# EasyEDA Pro project 智能车.eprj, board PCB4
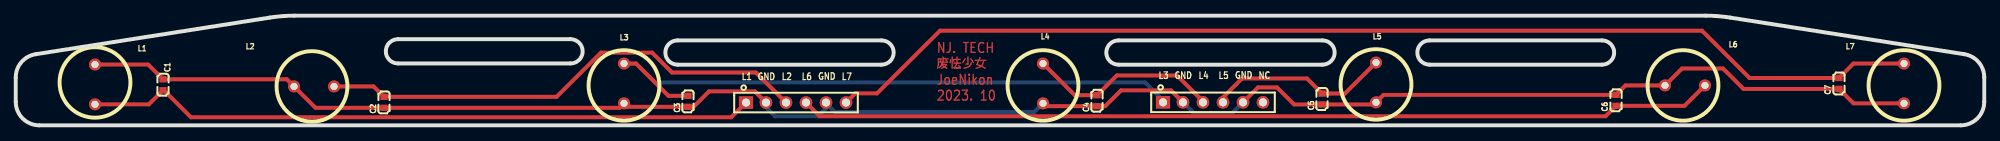
[diagram p14: board, top side]
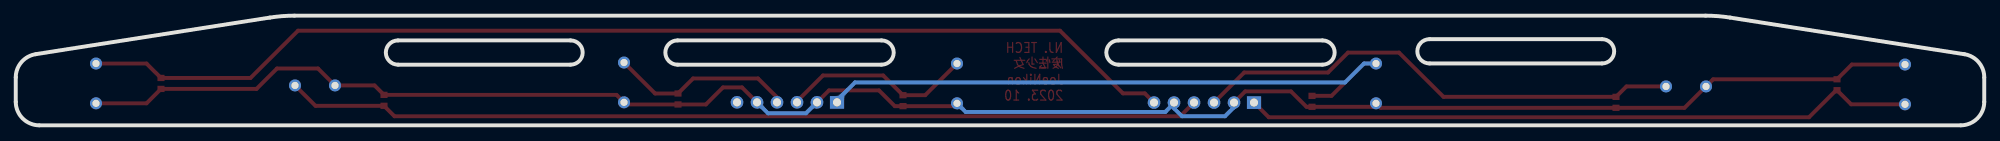
[diagram p15: board, bottom side, seen from below]

Outline 250 x 14 mm; copper layers: Top Layer, Bottom Layer. Coordinates in mm from the lower left corner of the outline.
Outline path: 0,6.12 0,3 arc(0.88,0.88) 3,0 247,0 arc(249.12,0.88) 250,3 250,6.12 arc(249.28,8.07) 247.47,9.08 217.7,13.76 arc(216.16,13.94) 214.6,14 35.4,14 arc(33.84,13.94) 32.29,13.76 2.53,9.08 arc(0.72,8.07) 0,6.12 ; 48.55,7.9 arc(47,9.45) 48.55,11 70.45,11 arc(72,9.45) 70.45,7.9 48.55,7.9 ; 84.05,7.74 arc(82.5,9.29) 84.05,10.84 109.95,10.84 arc(111.5,9.29) 109.95,7.74 84.05,7.74 ; 140.05,7.74 arc(138.5,9.29) 140.05,10.84 165.95,10.84 arc(167.5,9.29) 165.95,7.74 140.05,7.74 ; 179.55,7.74 arc(178,9.29) 179.55,10.84 201.45,10.84 arc(203,9.29) 201.45,7.74 179.55,7.74
Stack: Top Layer 0.035mm / Dielectric1 1.51mm FR4 er 4.5 / Bottom Layer 0.035mm

## Design rules (mm)
template: JLCPCB Capability(Two Layers Board)
spacing copperThickness1oz (default): track to track 0.102, other pairs 0.152 to 0.3
spacing copperThickness2oz: track to track 0.203, other pairs 0.152 to 0.3
track width copperThickness1oz (default): min 0.127, default 0.254, max 2.54
track width copperThickness2oz: min 0.203, default 0.254, max 2.54
differential pair differentialPair (default): width min 0.127, default 0.254, max 2.54; gap min 0.152, default 0.152
via viaSize (default): diameter min 0.5, default 0.61, max 10; hole min 0.3, default 0.305, max 6.3

## Placement (name value [footprint] x y rotation side)
C1  6.8nf  [C0603]  18.7 5.18 270 top
C2  6.8nf  [C0603]  46.77 2.94 90 top
C3  6.8nf  [C0603]  85.38 3.06 90 top
C4  6.8nf  [C0603]  137.32 3.15 90 top
C5  6.8nf  [C0603]  165.89 3.36 90 top
C6  6.8nf  [C0603]  203.23 3.19 270 top
C7  6.8nf  [C0603]  231.55 5.35 90 top
H1  -  [HDR-TH_6P-P2.54-V-F]  99.09 2.91 0 top
H2  -  [HDR-TH_6P-P2.54-V-F]  152.05 2.94 0 top
L1  10mH  [PK0810]  10.06 5.22 270 top
L2  10mH  [PK0810]  37.88 4.97 0 top
L3  10mH  [PK0810]  77.25 5.35 90 top
L4  10mH  [PK0810]  130.46 5.35 90 top
L5  10mH  [PK0810]  172.75 5.48 90 top
L6  10mH  [PK0810]  211.99 5.09 0 top
L7  10mH  [PK0810]  239.81 5.35 90 top

## Footprints (pads in the part's own frame, mm; a bottom-side part is the same pattern mirrored in y, then rotated)
C0603
  rect 0.8x0.9 smd: 1(-0.7,0) 2(0.7,0)
HDR-TH_6P-P2.54-V-F
  rect 1.8x1.6 hole 1.02: 1(-6.35,0)
  round 1.6 hole 1.02: 2(-3.81,0) 3(-1.27,0) 4(1.27,0) 5(3.81,0) 6(6.35,0)
PK0810
  round 1.524 hole 0.914x0.762: 1(-2.54,0) 2(2.54,0)

## Nets
As in the schematic.

Pads without a net: H2 6

## Via types
v1: diameter 0.61, hole 0.305, Top Layer to Bottom Layer, 1 via

## Routing (per net, layer and track width the routed paths; a pad name or vN(x,y) marks a point on that pad's centre or on a via; arc(x,y) is an arc through that point)
GND: length 245.2
  Top Layer w0.5: H2.2 146.72,4.46 140.37,4.46 138.35,2.45 C4.1 130.82,2.45 L4.1 ; H2.5 157.77,4.84 160.18,4.84 162.35,2.66 C5.1 172.48,2.66 L5.1 173.71,3.89 C6.1 204.44,5.09 209.45,5.09 211.61,7.25 216.82,7.25 219.43,4.65 C7.1 233.39,2.81 L7.1 ; L1.1 16.82,7.76 C1.1 34.43,5.88 L2.1 38.07,2.24 C2.1 76.67,2.24 L3.1 77.69,2.36 C3.1 86.08,2.36 88.05,4.33 93.86,4.33 H1.2
  Bottom Layer w0.5: H2.5 154.46,1.54 149.64,1.54 H2.2 ; 102.9,2.81 H1.5 ; 102.9,2.81 102.9,2.17 101.89,1.16 96.42,1.16 95.28,2.3 H1.2 ; 102.9,2.81 104.01,1.7 129.36,1.7 L4.1
L1: length 85.6
  Top Layer w0.5: H1.1 90.87,1.03 22.26,1.03 18.81,4.48 C1.2 16.9,2.68 L1.2
L2: length 62.9
  Top Layer w0.5: H1.3 93.98,6.75 83.34,6.75 80.8,9.29 74.33,9.29 68.68,3.64 C2.2 45.44,4.97 L2.2
L3: length 80.5
  Top Layer w0.5: L3.2 78.77,7.89 82.9,3.76 C3.2
  Bottom Layer w0.5: H2.1 145.7,3.19 143.41,5.48 81.18,5.48 78.77,7.89 L3.2
L4: length 24.5
  Top Layer w0.5: L4.2 134.5,3.85 C4.2 139.84,6.36 147.48,6.36 150.78,3.06 150.78,2.94
L5: length 23.5
  Top Layer w0.5: H2.4 153.32,3.57 155.73,5.98 163.97,5.98 C5.2 168.8,4.06 L5.2
L6: length 116.5
  Top Layer w0.5: L6.2 211.93,2.49 C6.2 201.9,1.16 102.11,1.16 H1.4
L7: length 141.4
  Top Layer w0.5: v1(239.81,7.89) 233.39,7.89 C7.2 220.18,6.05 214.15,12.08 117.38,12.08 109.38,4.08 106.61,4.08 H1.6

## Copper pours and planes (outline as drawn; the poured copper is in the pictures)
GND on Top Layer: -7.46,24.4 259.37,24.4 259.37,-7.86 -7.46,-7.86
GND on Bottom Layer: -13.94,33.16 267.62,33.16 267.62,-20.18 -13.94,-20.18

Small or netless copper shapes (teardrops, artwork), in the pictures only: 50 on Top Layer, 7 on Bottom Layer

## Text on the board
Top Layer: NJ. TECH / 废怯少女 / JoeNikon / 2023. 10
Top Silkscreen Layer: L1 | GND | L2 | L6 | L7 | L3 | L4 | L5 | NC
